# EasyEDA Pro project 天猛星1.eprj (continued)
## Notes on the sheet (continued)
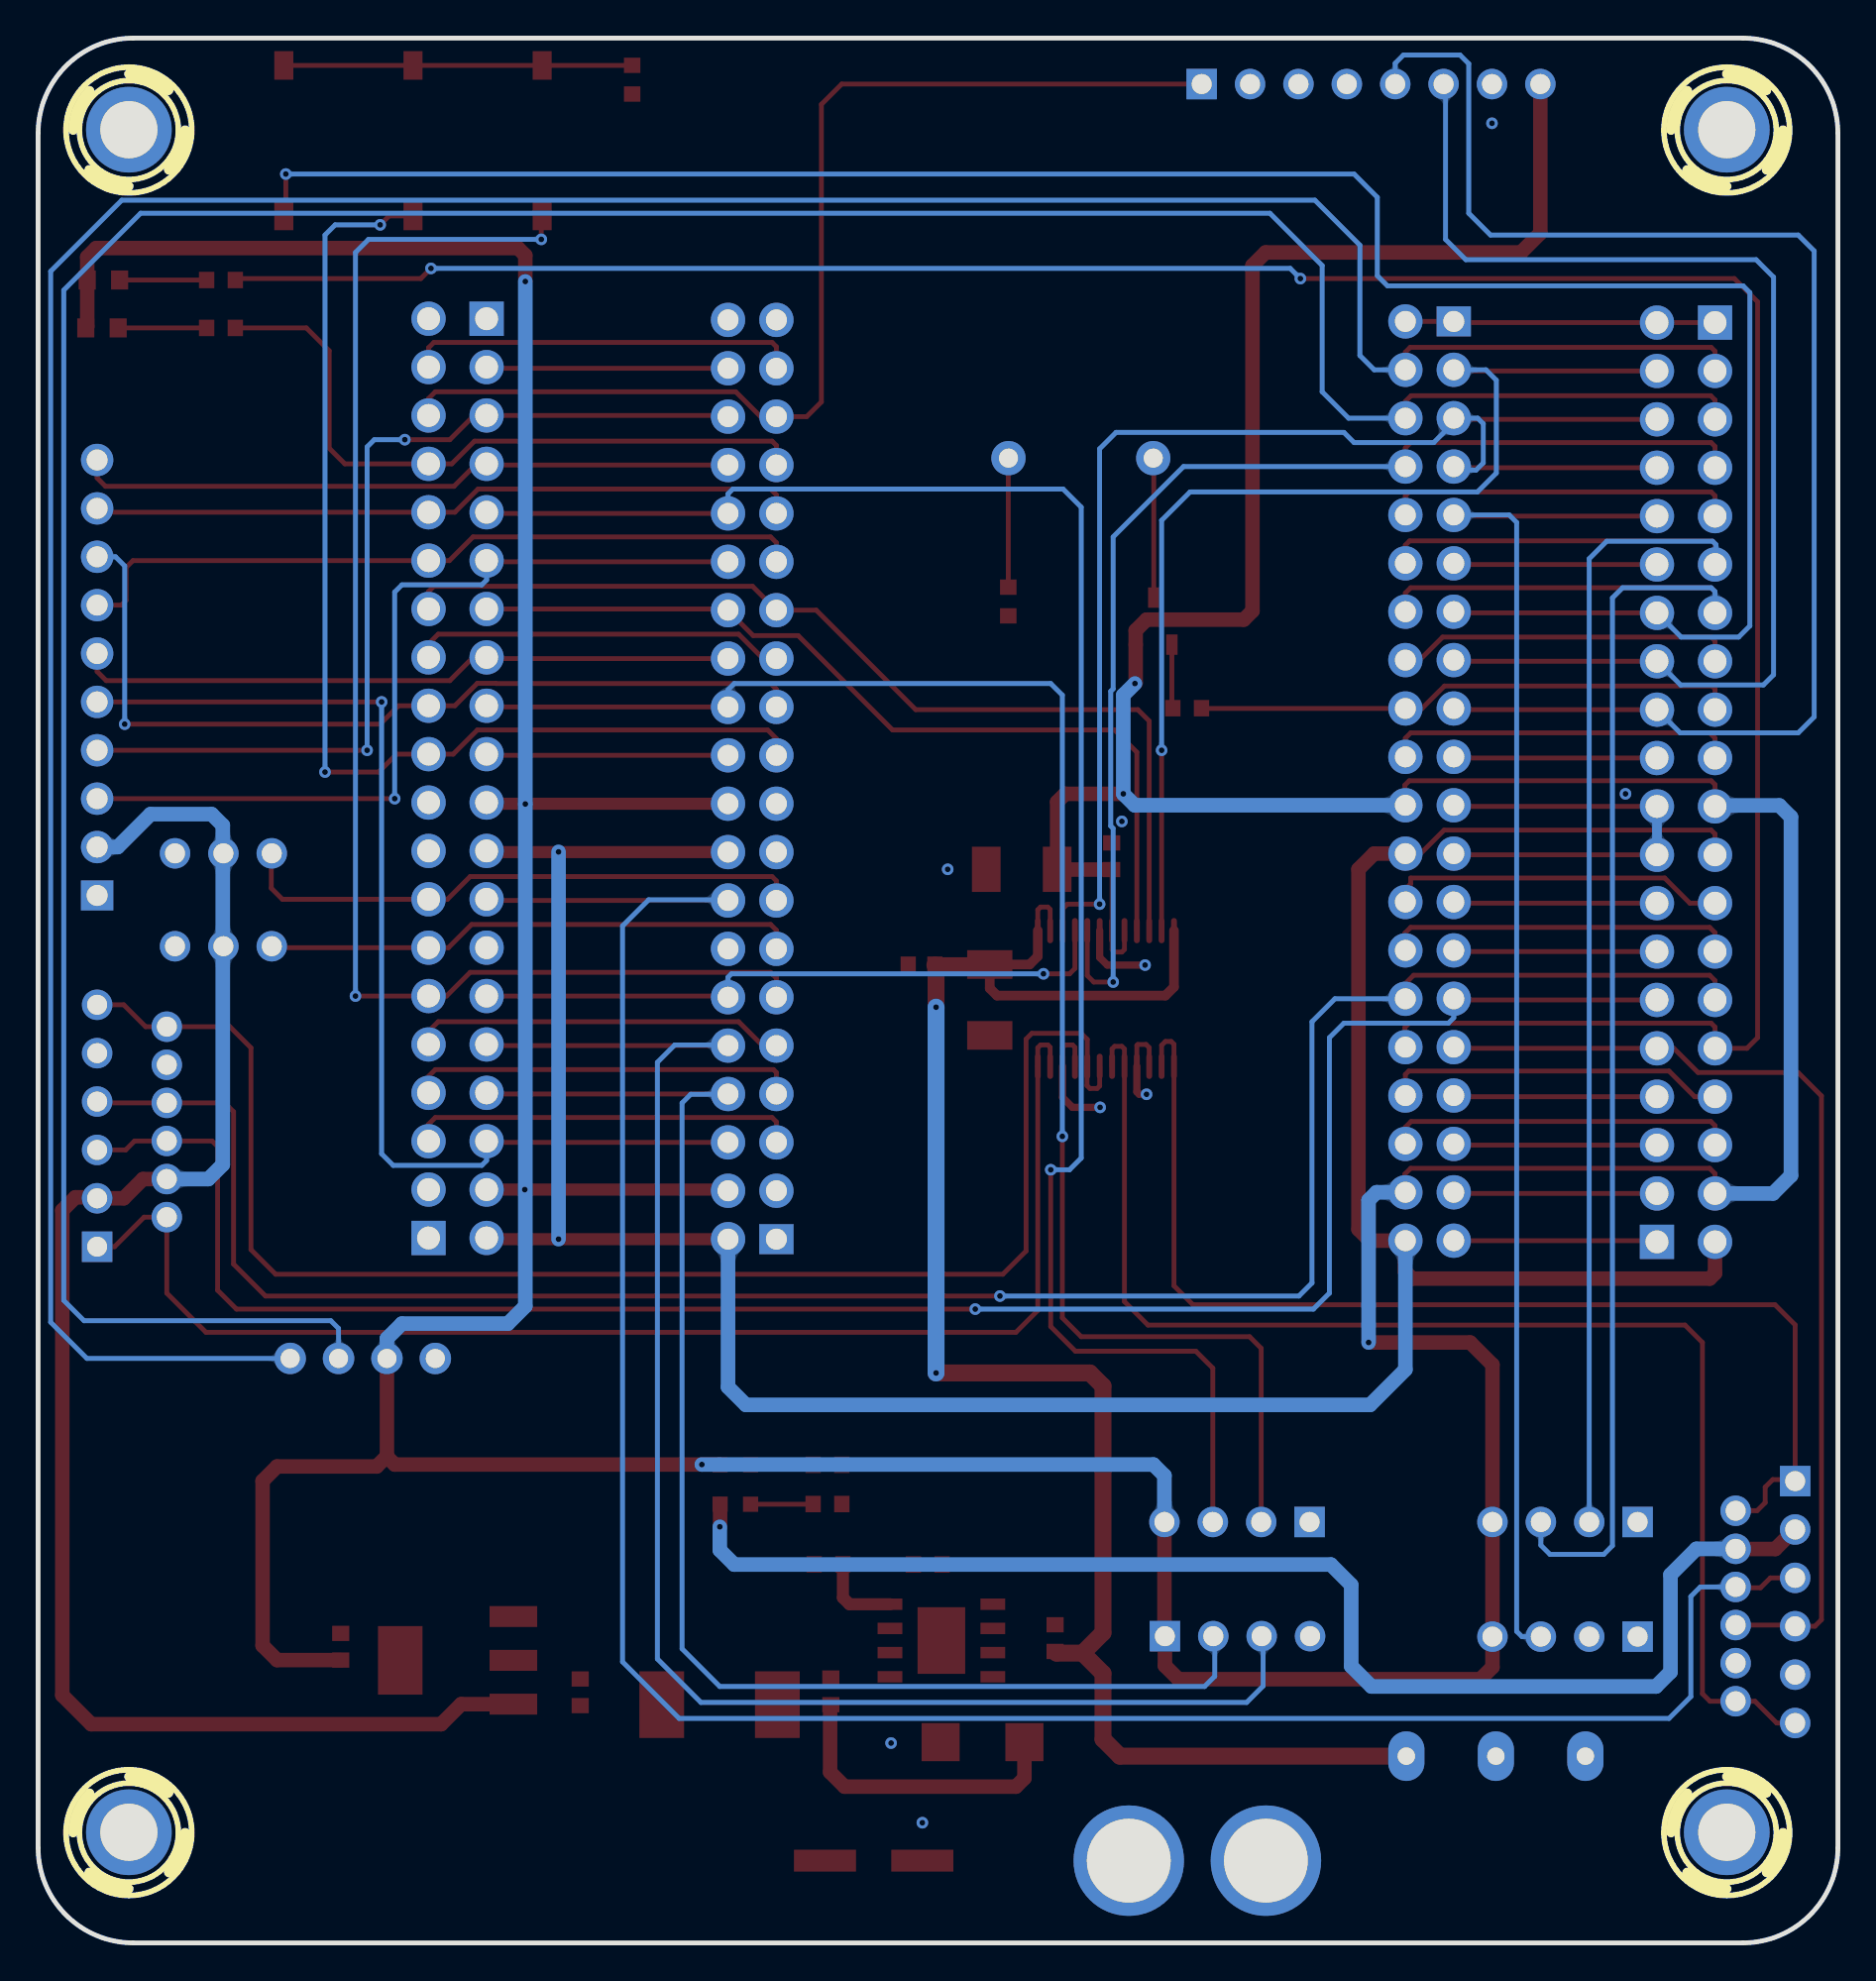
[diagram p2: board, bottom side, seen from below]

Outline 94.49 x 100 mm; copper layers: Top Layer, Bottom Layer. Coordinates in mm from the lower left corner of the outline.
Outline path: 0,95 0,5 arc(1.46,1.46) 5,0 89.49,0 arc(93.02,1.46) 94.49,5 94.49,95 arc(93.02,98.54) 89.49,100 5,100 arc(1.46,98.54) 0,95
Stack: Top Layer 0.035mm / Dielectric1 1.51mm FR4 er 4.5 / Bottom Layer 0.035mm

## Design rules (mm)
template: JLCPCB Capability(Two Layers Board)
spacing copperThickness1oz (default): track to track 0.102, other pairs 0.152 to 0.3
spacing copperThickness2oz: track to track 0.203, other pairs 0.152 to 0.3
track width copperThickness1oz (default): min 0.127, default 0.254, max 2.54
track width copperThickness2oz: min 0.203, default 0.254, max 2.54
differential pair differentialPair (default): width min 0.127, default 0.254, max 2.54; gap min 0.152, default 0.152
via viaSize (default): diameter min 0.5, default 0.61, max 10; hole min 0.3, default 0.305, max 6.3

## Placement (name value [footprint] x y rotation side)
C17  0.01uF  [C0603]  38.13 57.05 270 top
C18  10uF  [case-b_3528]  42.85 56.36 0 top
C19  0.01uF  [C0603]  48.11 51.33 180 top
C20  10uF  [case-b_3528]  44.53 49.5 270 top
C24  10uF  [C0603]  41.1 16 270 top
C25  0.01uF  [C0603]  52.87 13.21 90 top
C27  10uF  [C0603]  78.6 15.55 90 top
C28  10uF  [C0603]  66.03 13.16 270 top
C29  220uF  [CAP-SMD_BD6.3-L6.6-W6.6-LS7.2-R-RD]  50.62 4.32 0 top
D2  B340A  [SMA_L4.3-W2.6-LS5.1-RD]  44.91 10.54 0 top
H1  -  [HDR-TH_20P-P2.54-V-M-1]  6.45 60.93 270 top
H2  -  [HDR-TH_20P-P2.54-V-M-1]  9.5 60.93 90 top
H3  -  [HDR-TH_20P-P2.54-V-M-1]  73.99 61.14 90 top
H4  -  [HDR-TH_20P-P2.54-V-M-1]  70.94 61.14 270 top
H5  8路循迹  [HDR-TH_10P-P2.54-V-M]  91.39 66.42 90 top
LED3  -  [led0603_blue]  91.13 84.79 0 top
LED4  -  [led0603_blue]  91.06 87.3 0 top
LED5  -  [led_0603]  57.93 25.1 0 top
LED6  -  [led_0603]  57.93 23.04 0 top
MPU6050  -  [MPU6050-8p]  30.73 97.59 180 top
Q1  S8550  [SOT-23-3_L2.9-W1.6-P1.90-LS2.8-BR]  35.92 69.39 270 top
R8  10K  [R0603]  63.3 97.82 270 top
R9  100Ω  [R0603]  43.56 70.42 90 top
R10  100Ω  [R0603]  34.16 64.82 180 top
R11  4.7kΩ  [R0603]  84.89 84.79 180 top
R12  4.7kΩ  [R0603]  84.89 87.3 180 top
R13  10kΩ  [R0603]  53.05 23.04 180 top
R14  4.7kΩ  [R0603]  53.05 25.1 180 top
R15  10kΩ  [R0603]  52.99 19.87 0 top
R16  3.24kΩ  [R0603]  47.78 19.87 0 top
SCROW3  CON1  [LQ_SCROW3&5MM]  5.83 95.19 0 top
SCROW4  CON1  [LQ_SCROW3&5MM]  5.83 5.81 0 top
SCROW5  CON1  [LQ_SCROW3&5MM]  89.72 95.19 0 top
SCROW6  CON1  [LQ_SCROW3&5MM]  89.72 5.81 0 top
SW6  轻触按键3*6*2.5  [SW-SMD_L6.0-W3.6-LS8.0]  68.03 94.62 90 top
SW8  轻触按键3*6*2.5  [SW-SMD_L6.0-W3.6-LS8.0]  74.81 94.62 90 top
SW9  轻触按键3*6*2.5  [SW-SMD_L6.0-W3.6-LS8.0]  81.59 94.62 90 top
U4  LCKFB-TMX-MSPM0G3507  [COMM-TH_LCKFB-TMX-MSPM0G3507]  39.22 61.04 0 top
U5  -  [0.96OLED_4P]  77.44 30.68 0 top
U12  -  [拨动开关]  22.66 9.8 180 top
U17  TB6612FNG,C,8,EL  [SSOP-24_L8.3-W5.6-P0.65-LS7.6-BL]  38.43 49.58 0 top
U19  -  [XH2.54_4p]  15.72 22.23 0 top
U20  -  [XH2.54_4p]  32.94 22.23 0 top
U21  -  [X2.54_3p]  83.49 57.2 0 top
U22  -  [X2.54_3p]  83.49 52.32 0 top
U23  -  [XH2.54_6p]  1.99 17.13 270 top
U24  -  [XH2.54_6p]  91.64 43.66 90 top
U25  -  [XH2.54_4p]  15.72 16.21 0 top
U26  -  [XH2.54_4p]  30.12 15.98 180 top
U28  2.6kHz  [BUZ-TH_BD12.0-P7.60-D0.6-FD]  39.74 77.95 0 top
U29  -  [ph2.0]  5.37 17.61 270 top
U30  -  [ph2.0]  87.73 43.18 90 top
U31  AMS1117-3.3  [SOT-223-3_L6.5-W3.4-P2.30-LS7.0-BR]  72.5 14.83 180 top
U32  XT60  [CONN-TH_XT60]  33.63 4.32 180 top
U33  TPS5430DDAR  [ESOP-8_L4.9-W3.9-P1.27-LS6.0-TL-EP]  47.07 15.88 180 top
U34  15uH  [IND-SMD_L6.6-W6.6]  58.71 12.51 180 top

## Footprints (pads in the part's own frame, mm; a bottom-side part is the same pattern mirrored in y, then rotated)
0.96OLED_4P
  round 1.65 hole 1: 1(-3.81,-0.002) 2(-1.27,0.002) 3(1.27,0.002) 4(3.81,0.002)
BUZ-TH_BD12.0-P7.60-D0.6-FD
  round 1.8 hole 1: 1(-3.8,0) 2(3.8,0)
C0603
  rect 0.8x0.9 smd: 1(-0.7,0) 2(0.7,0)
CAP-SMD_BD6.3-L6.6-W6.6-LS7.2-R-RD
  rect 3.26x1.15 smd: 1(2.555,0) 2(-2.555,0)
case-b_3528
  rect 1.506x2.376 smd: 1(-1.861,0) 2(1.861,0)
COMM-TH_LCKFB-TMX-MSPM0G3507
  rect 1.8x1.575 hole 1.1: 1(-19.05,24.09) 41(16.51,-24.09)
  round 1.8 hole 1.1: 2(-16.51,24.09) 3(-19.05,21.549) 4(-16.51,21.549) 5(-19.05,19.009) 6(-16.51,19.009) 7(-19.05,16.47) 8(-16.51,16.47) 9(-19.05,13.93) 10(-16.51,13.93) 11(-19.05,11.389) 12(-16.51,11.389) 13(-19.05,8.85) 14(-16.51,8.85) 15(-19.05,6.309) 16(-16.51,6.309) 17(-19.05,3.769) 18(-16.51,3.769) 19(-19.05,1.23) 20(-16.51,1.23) 21(-19.05,-1.31) 22(-16.51,-1.31) 23(-19.05,-3.85) 24(-16.51,-3.85) 25(-19.05,-6.391) 26(-16.51,-6.391) 27(-19.05,-8.931) 28(-16.51,-8.931) 29(-19.05,-11.47) 30(-16.51,-11.47) 31(-19.05,-14.011) 32(-16.51,-14.011) 33(-19.05,-16.55) 34(-16.51,-16.55) 35(-19.05,-19.09) 36(-16.51,-19.09) 37(-19.05,-21.631) 38(-16.51,-21.631) 39(-19.05,-24.171) 40(-16.51,-24.171) 42(19.05,-24.09) 43(16.51,-21.549) 44(19.05,-21.549) 45(16.51,-19.009) 46(19.05,-19.009) 47(16.51,-16.47) 48(19.05,-16.47) 49(16.51,-13.93) 50(19.05,-13.93) 51(16.51,-11.389) 52(19.05,-11.389) 53(16.51,-8.85) 54(19.05,-8.85) 55(16.51,-6.309) 56(19.05,-6.309) 57(16.51,-3.769) 58(19.05,-3.769) 59(16.51,-1.23) 60(19.05,-1.23) 61(16.51,1.31) 62(19.05,1.31) 63(16.51,3.85) 64(19.05,3.85) 65(16.51,6.391) 66(19.05,6.391) 67(16.51,8.931) 68(19.05,8.931) 69(16.51,11.47) 70(19.05,11.47) 71(16.51,14.011) 72(19.05,14.011) 73(16.51,16.55) 74(19.05,16.55) 75(16.51,19.09) 76(19.05,19.09) 77(16.51,21.631) 78(19.05,21.631) 79(16.51,24.171) 80(19.05,24.171)
CONN-TH_XT60
  round 5.8 hole 4.4: 1(-3.6,0) 2(3.6,0)
ESOP-8_L4.9-W3.9-P1.27-LS6.0-TL-EP
  rect 1.3x0.6 smd: 1(-2.7,1.905) 2(-2.7,0.635) 3(-2.7,-0.635) 4(-2.7,-1.905) 5(2.7,-1.905) 6(2.7,-0.635) 7(2.7,0.635) 8(2.7,1.905)
  rect 2.5x3.5 smd: 9(0,0)
HDR-TH_10P-P2.54-V-M
  rect 1.575x1.7 hole 1.1: 1(-11.43,0)
  round 1.7 hole 1.1: 2(-8.89,0) 3(-6.35,0) 4(-3.81,0) 5(-1.27,0) 6(1.27,0) 7(3.81,0) 8(6.35,0) 9(8.89,0) 10(11.43,0)
HDR-TH_20P-P2.54-V-M-1
  rect 1.8x1.8 hole 1.2: 1(-24.13,0)
  round 1.8 hole 1.2: 2(-21.59,0) 3(-19.05,0) 4(-16.51,0) 5(-13.97,0) 6(-11.43,0) 7(-8.89,0) 8(-6.35,0) 9(-3.81,0) 10(-1.27,0) 11(1.27,0) 12(3.81,0) 13(6.35,0) 14(8.89,0) 15(11.43,0) 16(13.97,0) 17(16.51,0) 18(19.05,0) 19(21.59,0) 20(24.13,0)
IND-SMD_L6.6-W6.6
  rect 2.35x3.5 smd: 1(-3.035,0) 2(3.035,0)
led0603_blue
  rect 0.9x1 smd: 1(-0.85,0) 2(0.85,0)
led_0603
  rect 0.8x0.8 smd: 1(-0.851,-0.01) 2(0.75,-0.005)
LQ_SCROW3&5MM
  round 4.5 hole 3: 1(0,0)
MPU6050-8p
  rect 1.6x1.6 hole 1.05: 1(-2.667,0)
  round 1.6 hole 1.05: 2(-0.127,0) 3(2.413,0) 4(4.953,0) 5(7.493,0) 6(10.033,0) 7(12.573,0) 8(15.113,0)
ph2.0
  round 1.6 hole 1.05: 1(-5.08,0) 2(-3.08,0) 3(-1.08,0) 4(0.92,0) 5(2.92,0) 6(4.92,0)
R0603
  rect 0.806x0.864 smd: 1(-0.753,0) 2(0.753,0)
SMA_L4.3-W2.6-LS5.1-RD
  rect 2x2 smd: 1(-2.2,0) 2(2.2,0)
SOT-23-3_L2.9-W1.6-P1.90-LS2.8-BR
  rect 1.07x0.6 smd: 1(1.235,-0.95) 2(1.235,0.95) 3(-1.235,0)
SOT-223-3_L6.5-W3.4-P2.30-LS7.0-BR
  rect 2.5x1.1 smd: 1(2.97,-2.3) 2(2.97,0) 3(2.97,2.3)
  rect 2.34x3.6 smd: 4(-2.97,0)
SSOP-24_L8.3-W5.6-P0.65-LS7.6-BL
  oval 0.308x1.324 smd: 1(-3.575,-3.562) 2(-2.925,-3.562) 3(-2.275,-3.562) 4(-1.625,-3.562) 5(-0.975,-3.562) 6(-0.325,-3.562) 7(0.325,-3.562) 8(0.975,-3.562) 9(1.625,-3.562) 10(2.275,-3.562) 11(2.925,-3.562) 12(3.575,-3.562) 13(3.575,3.562) 14(2.925,3.562) 15(2.275,3.562) 16(1.625,3.562) 17(0.975,3.562) 18(0.325,3.562) 19(-0.325,3.562) 20(-0.975,3.562) 21(-1.625,3.562) 22(-2.275,3.562) 23(-2.925,3.562) 24(-3.575,3.562)
SW-SMD_L6.0-W3.6-LS8.0
  rect 1.5x1 smd: 1(-3.95,0) 2(3.95,0)
X2.54_3p
  round 1.6 hole 1.05: 1(-1.27,0) 2(1.27,0) 3(3.81,0)
XH2.54_4p
  rect 1.6x1.6 hole 1.05: 1(-5.207,-0.127)
  round 1.6 hole 1.05: 2(-2.667,-0.127) 3(-0.127,-0.127) 4(2.413,-0.127)
XH2.54_6p
  rect 1.6x1.6 hole 1.05: 1(-7.112,0.254)
  round 1.6 hole 1.05: 2(-4.572,0.254) 3(-2.032,0.254) 4(0.508,0.254) 5(3.048,0.254) 6(5.588,0.254)
拨动开关
  oval 1.9x2.6 hole 0.914: 1(0,0) 2(4.7,0) 3(9.4,0)

## Nets
As in the schematic, except:
3V3: C17.2 C18.1 C27.1 H1.11 H1.19 H4.11 H4.19 LED3.2 LED4.2 LED5.2 MPU6050.8 Q1.2 U4.22 U4.38 U4.44 U4.60 U5.2 U17.19 U17.20 U19.4 U20.4 U25.4 U26.1 U31.2 U31.4
GND: C17.1 C18.2 C19.1 C20.2 C24.1 C27.2 C28.1 C29.2 D2.2 H1.1 H2.1 H2.2 H2.9 H2.10 H2.20 H3.1 H3.2 H3.9 H3.10 H3.20 H4.1 H4.14 H5.1 MPU6050.7 R8.2 R9.1 R13.2 R14.2 R16.1 U4.1 U4.2 U4.21 U4.23 U4.37 U4.39 U4.41 U4.43 U4.54 U4.57 U4.59 U4.79 U4.80 U5.1 U17.3 U17.4 U17.9 U17.10 U17.18 U19.1 U20.1 U21.3 U22.3 U23.5 U24.5 U25.1 U26.4 U29.5 U30.5 U31.1 U32.1 U33.6 U33.9
MPU_IN: H3.18 MPU6050.1 U4.75
MPU_SCL: H2.13 MPU6050.6 U4.15
MPU_SDA: H2.12 MPU6050.5 U4.17
OLED_SCL: H1.3 U4.6 U5.3
OLED_SDA: H1.2 U4.4 U5.4

Pads without a net: MPU6050 2 3 4; SCROW3 1; SCROW4 1; SCROW5 1; SCROW6 1; U12 3; U33 2 3 5

## Via types
v1: diameter 0.61, hole 0.305, Top Layer to Bottom Layer, 41 vias

## Routing (per net, layer and track width the routed paths; a pad name or vN(x,y) marks a point on that pad's centre or on a via; arc(x,y) is an arc through that point)
3V3: length 397.2
  Top Layer w0.254: 37.45,53.14 37.45,52.16 37.59,52.02 37.97,52.02 38.11,52.15 U17.19 38.11,56.33 C17.2 ; 22.71,59.73 22.73,59.75 22.73,60.78 22.5,61.01 6.65,61.01 6.45,60.81 H1.11 ; H1.19 6.45,40.39 6.73,40.67 22.43,40.67 22.73,40.36 22.73,39.43 22.71,39.41
  Top Layer w0.635: H4.11 70.88,59.81 U4.60 ; U4.44 58.33,39.55 v1(68.94,39.55) H4.19
  Top Layer w0.762: 76.17,25.55 76.71,25.01 81.94,25.01 82.7,24.25 82.7,15.61 81.94,14.85 C27.1 ; 76.17,25.55 U5.2 ; 76.17,25.55 76.17,25.53 75.76,25.11 v1(59.64,25.11) 58.7,25.11 LED5.2 ; U20.4 35.36,16.13 U26.1 35.33,14.55 34.62,13.84 18.77,13.84 18.14,14.48 U25.4 U19.4 18.14,30.35 19.3,31.52 v1(24.64,31.52) ; LED3.2 91.91,84.86 LED4.2 91.91,88.51 91.44,88.98 69.29,88.98 68.91,88.6 v1(68.91,87.22) ; 15.62,97.59 15.62,89.76 16.64,88.75 30.05,88.75 30.73,88.06 30.73,69.93 31.19,69.47 36.3,69.47 36.87,68.9 36.87,66.16 v1(36.91,66.12) ; v1(37.52,60.33) 40.56,60.33 40.99,59.9 C18.1 40.97,56.35 C17.2
  Bottom Layer w0.762: v1(36.91,66.12) 37.52,65.51 v1(37.52,60.33) 36.92,59.73 22.71,59.73 ; U5.2 76.17,31.72 75.39,32.51 69.82,32.51 68.91,33.43 v1(68.91,59.79) v1(68.91,87.22) ; v1(59.64,25.11) 35.93,25.11 35.36,24.54 U20.4 ; v1(24.64,31.52) 24.64,38.99 24.22,39.41 22.71,39.41 ; H1.11 6.4,59.72 3.07,59.72 2.46,59.11 2.46,40.28 3.4,39.34 H1.19
5V: length 159.2
  Top Layer w0.254: 22.71,57.19 21.91,57.19 20.68,58.42 6.65,58.42 6.45,58.22 H1.12
  Top Layer w0.635: U4.42 v1(67.16,36.95) 70.88,36.95 H4.20 ; U4.58 70.88,57.27 H4.12
  Top Layer w0.762: H1.20 6.45,35.15 6.73,34.87 22.35,34.87 22.73,35.26 22.73,36.84 22.71,36.87 24.57,36.87 25.17,37.47 25.17,56.36 24.35,57.19 22.71,57.19
  Bottom Layer w0.762: v1(67.16,36.95) v1(67.16,57.28) ; 22.71,36.87 22.71,30.1 24.56,28.25 57.33,28.25 58.27,29.18 U4.42
+5V: length 155.8
  Top Layer w0.762: U31.3 72.28,12.53 73.33,11.48 91.69,11.48 93.22,13.01 93.22,38.46 92.53,39.14 91.44,39.14 U24.2 89.99,39.09 88.98,40.1 U30.2 ; 2.28,21.69 3.29,20.68 5.43,20.68 ; v1(58.7,21.84) 58.68,21.86 LED6.2
  Bottom Layer w0.762: U29.2 7.43,20.69 8.79,19.33 8.79,14.22 9.55,13.46 24.49,13.46 25.55,14.53 25.55,18.8 26.62,19.86 57.94,19.86 58.7,20.62 v1(58.7,21.84) ; U30.2 85.55,40.1 84.79,40.86 84.79,58.67 85.38,59.26 88.58,59.26 90.31,57.53 H5.2
+12V: length 91.6
  Top Layer w0.254: U17.14 41.36,54.26 41.48,54.38 41.86,54.38 42.01,54.24 U17.13
  Top Layer w0.508: U17.13 42.01,51.8 42.44,51.37 C20.1 44.53,50.11 44.14,49.73 35.31,49.73 34.85,50.18 34.85,53.14
  Top Layer w0.762: C20.1 47.33,51.37
  Top Layer w0.889: U12.1 37.69,9.8 38.58,10.69 38.58,14.15 39.65,15.21 ; v1(47.35,29.92) 39.27,29.92 38.58,29.24 38.58,16.28 39.65,15.21 ; 39.65,15.21 41.02,15.21 41.03,15.23 ; C19.2 47.35,51.27 v1(47.35,49.12)
  Bottom Layer w0.889: v1(47.35,29.92) v1(47.35,49.12)
GND: length 76.9
  Top Layer w0.254: H2.1 9.56,36.87 20.17,36.87 ; 20.17,57.19 20.11,57.12 H2.9 ; 70.88,85.21 H4.1 ; H1.1 H2.20 20.11,85.06 20.17,85.13 22.71,85.13 ; U17.10 40.71,47 40.56,47.14 40.18,47.14 40.06,47.02 40.06,46.02 ; U17.3 36.16,47 36.32,47.17 36.75,47.17 36.81,47.12 U17.4 ; H2.2 20.11,39.34 20.17,39.41 ; H2.10 20.11,59.66 20.17,59.73
  Top Layer w0.381: U17.4 36.81,44.68 36.68,44.55 v1(36.3,44.55) ; v1(38.73,43.87) 40.18,43.87 40.71,44.39 U17.10 ; 38.76,53.14 38.76,51.73 38.35,51.33 v1(36.37,51.33)
  Bottom Layer w0.508: H2.10 H2.9
  vias: v1(11.15,60.33) v1(18.16,95.53) v1(37.59,58.88) v1(46.74,56.36) v1(48.06,6.31) v1(49.71,10.49)
AIN1: length 46.6
  Top Layer w0.254: H4.7 58.33,70.03 U4.68 58.27,69.95 56.95,68.63 54.58,68.63 49.63,63.68 37.97,63.68 36.81,62.51 U17.21
AIN2: length 52.8
  Top Layer w0.254: H3.14 73.99,70.94 73.71,71.22 56.98,71.22 U4.67 53.63,69.97 48.41,64.74 36.75,64.74 36.16,64.15 U17.22
AO1: length 60.7
  Top Layer w0.254: U29.1 5.43,22.69 ; 5.43,22.69 5.43,22.69 ; 5.43,22.69 5.45,22.67 ; 5.43,22.69 5.36,22.76 ; 5.43,22.69 4.24,22.69 3.82,23.11 3.82,23.93 3.42,24.32 2.31,24.32 ; U23.1 2.24,32.45 3.3,33.5 33.86,33.5 34.85,34.5 34.85,47.18 35,47.32 35.31,47.32 35.5,47.13 U17.2
AO2: length 70.1
  Top Layer w0.254: U23.6 3.21,11.54 4.36,12.69 U29.6 6.72,12.69 7.11,13.08 7.11,31.52 8.03,32.44 36.22,32.44 37.45,33.67 37.45,46.93 37.59,47.07 37.97,47.07 38.11,46.94 U17.6
BIN1: length 62.8
  Top Layer w0.254: U17.17 39.41,50.78 39.06,50.44 v1(38.05,50.44) ; 22.71,77.51 22.71,78.49 22.43,78.77 6.65,78.77 6.45,78.56 H1.4
  Bottom Layer w0.254: v1(38.05,50.44) 38.05,58.51 38.18,58.64 38.18,65.71 38.05,65.84 38.05,73.81 34.36,77.51 22.71,77.51
BIN2: length 34.1
  Top Layer w0.254: H4.15 58.33,49.71 U4.52 ; v1(41.71,50.88) 40.34,50.88 40.06,51.16 40.06,53.14
  Bottom Layer w0.254: v1(41.71,50.88) 58.09,50.88 58.27,50.7 58.27,49.65 U4.52
BO1: length 70.9
  Top Layer w0.254: U17.11 41.36,47.02 41.48,47.14 41.86,47.14 42.01,47 U17.12 42.01,33.2 43.15,32.06 85.67,32.06 87.73,34.11 U30.1 88.93,38.1 90.47,36.55 U24.1
BO2: length 80.2
  Top Layer w0.254: 38.76,46.02 38.76,44.99 38.89,44.86 39.27,44.86 39.42,45.01 39.42,46 U17.8 39.41,47.43 39.73,47.75 42.32,47.75 42.62,47.45 42.62,36.32 43.84,35.1 82.02,35.1 83.31,36.4 83.31,46.99 84.42,48.1 U30.6 88.84,48.1 89.99,49.25 U24.6
BUZZER: length 28.6
  Top Layer w0.254: H1.9 6.45,65.84 6.6,65.99 20.66,65.99 21.83,64.81 33.39,64.81 R10.2
ECHO: length 83.8
  Top Layer w0.254: H4.16 70.88,47.11 U4.50
  Bottom Layer w0.254: 30.17,16.1 30.17,13.49 31.04,12.62 59.69,12.62 61.98,14.91 61.98,46.23 61.06,47.14 58.3,47.14 U4.50
KEY1: length 74.1
  Top Layer w0.254: v1(77.83,49.71) H3.6 73.05,49.71 71.81,50.95 56.03,50.95 55.73,50.65 U4.51 ; v1(68.07,89.43) 68.07,90.62 SW6.1
  Bottom Layer w0.254: v1(77.83,49.71) 77.83,88.75 77.14,89.43 v1(68.07,89.43)
KEY2: length 58.9
  Top Layer w0.254: SW8.1 76.06,90.67 v1(76.53,90.2) ; U4.61 55.73,63.22 56.19,63.68 71.42,63.68 72.69,62.41 H3.11 75.67,62.41 76.61,61.47 v1(79.43,61.47)
  Bottom Layer w0.254: v1(79.43,61.47) 79.43,89.66 78.89,90.2 v1(76.53,90.2)
KEY3: length 117.9
  Top Layer w0.254: SW9.1 81.48,90.77 v1(81.48,92.86) ; 20.17,69.89 20.11,69.82 H2.14
  Bottom Layer w0.254: v1(81.48,92.86) 25.4,92.86 24.18,91.64 24.18,87.53 23.65,87 4.98,87 4.62,86.64 4.62,69.14 5.21,68.55 8.23,68.55 H2.14
L1: length 34.8
  Top Layer w0.254: U4.66 70.88,67.43 H4.8 71.65,67.49 72.87,66.27 90.91,66.27 91.39,66.75 H5.6
L2: length 58.2
  Top Layer w0.254: U4.46 70.88,42.03 H4.18 ; H5.5 v1(76.45,65.15)
  Bottom Layer w0.254: v1(76.45,65.15) 76.45,41.43 75.84,40.82 71.2,40.82 70.94,41.07 H4.18
L3: length 49.8
  Top Layer w0.254: v1(75.23,78.92) 72.87,78.92 71.6,80.19 H4.3 58.33,80.19 U4.76 ; H5.4 v1(77.22,62.61)
  Bottom Layer w0.254: v1(77.22,62.61) 77.22,78.54 76.84,78.92 v1(75.23,78.92)
L4: length 45.3
  Top Layer w0.254: H4.6 70.88,72.51 U4.70 ; H5.3 v1(75.77,60.07)
  Bottom Layer w0.254: v1(75.77,60.07) 75.77,70.92 75.39,71.3 71.2,71.3 70.94,71.55 70.94,72.57 H4.6
L_ENCA: length 105.4
  Top Layer w0.254: 20.17,49.57 20.11,49.5 H2.6 ; v1(45.29,33.27) 84.07,33.27 85.06,34.26 85.06,41.81 85.36,42.1 U30.3 89.42,42.1 89.89,41.63 U24.3
  Bottom Layer w0.254: 20.17,49.57 20.17,48.57 20.45,48.29 25.93,48.29 26.7,47.52 26.7,34.11 27.53,33.27 v1(45.29,33.27)
L_ENCB: length 110.5
  Top Layer w0.254: U24.4 91.32,44.1 U30.4 84.69,44.1 84.23,43.64 84.23,35.64 82.55,33.96 v1(43.99,33.96) ; H1.15 6.45,50.52 6.73,50.8 22.28,50.8 22.71,50.37 22.71,49.57
  Bottom Layer w0.254: v1(43.99,33.96) 28.3,33.96 27.61,34.65 27.61,48.36 26.41,49.57 22.71,49.57
LED3: length 36
  Top Layer w0.254: R11.2 80.4,84.79 79.21,83.59 79.21,78.47 78.38,77.65 H3.17 72.77,77.65 71.58,78.84 55.96,78.84 55.73,78.61 U4.73
LED4: length 140.6
  Top Layer w0.254: v1(73.86,87.91) 74.4,87.38 84.06,87.38 R12.2 ; v1(28.22,87.38) 5.44,87.38 4.22,86.16 4.22,47.52 4.77,46.96 H1.16 6.45,48.08 6.65,48.29 22.5,48.29 22.73,48.06 22.73,47.05 22.71,47.03
  Bottom Layer w0.254: v1(73.86,87.91) 28.75,87.91 v1(28.22,87.38)
MPU_IN: length 58.5
  Top Layer w0.254: H3.18 73.99,81.08 73.63,81.43 57.86,81.43 56.56,80.13 U4.75 54.14,80.13 53.37,80.9 53.37,96.52 52.3,97.59 MPU6050.1
MPU_SCL: length 64.7
  Top Layer w0.254: H2.13 20.11,67.28 20.17,67.35
  Bottom Layer w0.254: 20.7,97.59 20.6,97.49 20.6,89.43 19.53,88.37 4.29,88.37 3.38,87.45 3.38,66.57 3.91,66.04 8.25,66.04 H2.13
MPU_SDA: length 76.4
  Top Layer w0.254: 20.17,64.81 20.11,64.74 H2.12
  Bottom Layer w0.254: H2.12 8.28,63.53 2.08,63.53 1.24,64.36 1.24,88.82 2.08,89.66 18.24,89.66 19.38,90.81 19.38,98.65 19.84,99.11 22.81,99.11 23.24,98.68 23.24,97.59
OLED_SCL: length 168.5
  Top Layer w0.254: H1.3 6.45,81 6.68,81.23 22.41,81.23 22.71,80.92 22.71,80.05
  Bottom Layer w0.254: U5.3 78.71,32.26 79.12,32.66 92.07,32.66 93.14,33.73 93.14,86.77 89.1,90.81 29.82,90.81 27.08,88.06 27.08,81.43 25.69,80.05 22.71,80.05
OLED_SDA: length 166.7
  Top Layer w0.254: H1.2 6.45,83.56 6.65,83.77 22.45,83.77 22.71,83.51 22.71,82.59
  Bottom Layer w0.254: U5.4 91.92,30.68 93.83,32.59 93.83,87.76 90.09,91.49 27.46,91.49 25.09,89.13 25.09,83.34 24.34,82.59 22.71,82.59
PA0: length 58.2
  Top Layer w0.254: H2.19 20.11,82.52 20.17,82.59 ; U17.23 v1(35.5,62.61)
  Bottom Layer w0.254: v1(35.5,62.61) 35.5,74.68 34.01,76.17 18.92,76.17 17.93,77.17 17.93,82.04 18.48,82.59 20.17,82.59
PA1: length 73.9
  Top Layer w0.254: 20.17,80.05 20.11,79.98 H2.18 ; 20.17,77.51 20.11,77.44 H2.17 ; v1(38.76,54.53) 40.45,54.53 40.71,54.28 U17.15
  Bottom Layer w0.254: v1(38.76,54.53) 38.76,78.44 37.9,79.3 25.93,79.3 25.4,78.77 21.22,78.77 20.05,79.93 20.17,80.05 18.91,80.05 18.62,79.76 18.62,77.7 19,77.32 19.98,77.32 20.17,77.51
PA9: length 73.8
  Top Layer w0.254: H2.16 20.11,74.9 20.17,74.97
  Bottom Layer w0.254: 20.17,74.97 17.26,74.97 16.87,74.57 16.87,16.36 16.59,16.08 U25.3
PA10: length 77.2
  Top Layer w0.254: H1.6 6.45,73.46 6.6,73.61 22.48,73.61 22.71,73.38 22.71,72.43
  Bottom Layer w0.254: H1.6 6.4,72.42 6.4,73.4 6.58,73.58 12.14,73.58 13.06,72.67 U19.2
PA11: length 80.5
  Top Layer w0.254: H1.7 6.45,70.94 6.65,71.15 22.43,71.15 22.71,70.87 22.71,69.89
  Bottom Layer w0.254: H1.7 6.45,70.94 6.65,71.15 11.3,71.15 11.84,70.61 11.84,20.85 12.29,20.4 15.11,20.4 15.6,20.88 U19.3
PA14: length 39.3
  Top Layer w0.254: U4.69 55.73,73.51 56.03,73.81 71.65,73.81 72.9,72.57 H3.15 89.51,72.57 89.86,72.21 89.86,70.49 90.12,70.23 H5.7
PA21: length 84.5
  Top Layer w0.254: v1(40.72,42.34) 40.72,32.82 39.73,31.83 30.89,31.83 30.28,31.22 U20.2 ; U4.64 70.88,64.89 H4.9
  Bottom Layer w0.254: v1(40.72,42.34) 40.72,65.51 41.33,66.12 57.94,66.12 58.27,65.79 U4.64
PA22: length 94.5
  Top Layer w0.254: 32.82,22.1 32.82,30.18 33.71,31.06 40.03,31.06 41.33,32.36 v1(41.33,40.59) ; H4.5 70.88,75.05 U4.72
  Bottom Layer w0.254: U4.72 58.27,76.07 58.01,76.33 40.68,76.33 39.73,75.37 39.73,41.2 40.34,40.59 v1(41.33,40.59)
PA23: length 12.7
  Top Layer w0.254: U4.62 70.88,62.35 H4.10
PA26: length 12.7
  Top Layer w0.254: U4.78 70.88,82.67 H4.2
PA27: length 20.6
  Top Layer w0.254: H3.19 73.99,83.74 73.71,84.02 55.96,84.02 55.73,83.79 U4.77
PA29: length 18
  Top Layer w0.254: 22.71,44.49 22.71,45.59 22.53,45.77 8.86,45.77 7.52,44.42 H1.17
PA30: length 28.1
  Top Layer w0.254: U4.53 55.73,53.16 56.03,53.47 71.73,53.47 72.95,52.25 H3.7 82.14,52.25 U22.1
PB5: length 18.5
  Top Layer w0.254: 22.71,74.97 22.71,75.97 22.5,76.17 6.65,76.17 6.45,75.97 H1.5
PB6: length 10.7
  Top Layer w0.254: 20.17,54.65 20.11,54.58 H2.8
PB7: length 17.9
  Top Layer w0.254: 22.71,54.65 22.71,55.32 22.43,55.6 22.43,55.91 9.09,55.91 7.77,54.58 H1.13
PB8: length 10.7
  Top Layer w0.254: 20.17,52.11 20.11,52.04 H2.7
PB9: length 18.4
  Top Layer w0.254: H1.14 6.45,53.04 6.73,53.31 22.43,53.31 22.73,53.01 22.73,52.13 22.71,52.11
PB10: length 19.7
  Top Layer w0.254: U4.49 56.45,47.11 57.71,48.36 73.48,48.36 73.99,47.85 H3.5
PB11: length 20.5
  Top Layer w0.254: H3.4 73.99,45.49 73.63,45.85 55.88,45.85 55.73,45.69 U4.47
PB12: length 17.9
  Top Layer w0.254: H1.8 6.45,68.35 6.65,68.55 20.75,68.55 21.96,67.35 22.71,67.35
PB14: length 75.1
  Top Layer w0.254: U4.48 70.88,44.57 H4.17
  Bottom Layer w0.254: U4.48 58.28,44.55 60.22,44.55 60.68,44.09 60.68,15.44 58.7,13.46 33.25,13.46 32.72,14 32.72,16.1
PB15: length 10.7
  Top Layer w0.254: 20.17,72.43 20.11,72.36 H2.15
PB17: length 19.7
  Top Layer w0.254: U4.65 56.43,67.43 57.71,68.71 73.48,68.71 73.99,68.2 H3.13
PB19: length 46.1
  Top Layer w0.254: v1(89.94,63.98) 76.53,63.98 75.56,64.95 H3.12 72.61,64.95 71.43,66.13 70.45,66.13 70.44,66.12 56.03,66.12 55.73,65.81 U4.63
  Bottom Layer w0.254: H5.8 90.42,72.77 89.94,72.29 v1(89.94,63.98)
PB20: length 37.4
  Top Layer w0.254: H5.9 91.19,75.11 H3.16 72.61,75.11 71.39,76.33 56.03,76.33 55.73,76.02 U4.71
PB21: length 30.2
  Top Layer w0.254: U21.1 82.25,57.18 82.25,55.37 81.66,54.79 H3.8 73,54.79 71.81,55.98 55.96,55.98 55.73,55.75 U4.55
PB22: length 126.4
  Top Layer w0.254: U4.56 70.88,54.73 H4.13 ; U23.3 3.54,19.16 4.06,18.64 5.32,18.64 U29.3
  Bottom Layer w0.254: U4.56 58.3,54.76 62.43,54.76 63.81,53.39 63.81,14.76 60.83,11.79 8.86,11.79 7.72,12.93 7.72,18.19 7.22,18.69 U29.3
PB23: length 52.5
  Top Layer w0.254: U29.4 2.31,16.69 U23.4 1.21,16.62 0.86,16.97 0.86,44.47 2.09,45.69 7.34,45.69 8.61,46.96 H2.5 20.11,46.96 20.17,47.03
PB24: length 34.8
  Top Layer w0.254: U4.74 70.88,77.59 H4.4 71.48,77.65 72.65,76.47 90.95,76.47 91.39,76.91 H5.10
PB27: length 10.7
  Top Layer w0.254: 20.17,44.49 20.11,44.42 H2.4
$1N3235: length 10.7
  Top Layer w0.254: 20.17,62.27 20.11,62.2 H2.11
$1N3243: length 10.7
  Top Layer w0.254: 20.17,41.95 20.11,41.88 H2.3
$1N3271: length 18.4
  Top Layer w0.254: H1.18 6.45,42.9 6.68,43.13 22.41,43.13 22.71,42.82 22.71,41.95
$1N3274: length 18.5
  Top Layer w0.254: 22.71,62.27 22.71,63.25 22.43,63.53 6.73,63.53 6.45,63.25 H1.10
$1N3374: length 20.5
  Top Layer w0.254: H3.3 73.99,42.98 73.63,43.33 55.96,43.33 55.73,43.1 U4.45
$1N5970: length 18.3
  Top Layer w0.254: SW9.2 SW8.2 SW6.2 63.3,98.57 R8.1
$1N5979: length 4.7
  Top Layer w0.254: R11.1 90.27,84.79 90.31,84.82
$1N5981: length 4.6
  Top Layer w0.254: R12.1 90.19,87.3 90.23,87.34
$1N5986: length 7.3
  Top Layer w0.254: U28.1 35.92,77.92 Q1.3
$1N5988: length 3.2
  Top Layer w0.254: 34.97,68.16 34.97,65.18 34.84,65.05
$1N5990: length 6.8
  Top Layer w0.254: U28.2 43.56,77.94 R9.2
$1N7998: length 3.3
  Top Layer w0.254: R14.1 57.07,25.1 LED5.1
$1N8000: length 3.3
  Top Layer w0.254: LED6.1 53.81,23.03 R13.1
$1N8508: length 16.1
  Top Layer w0.762: C25.1 52.91,12.47 52.91,8.97 52.15,8.2 43.15,8.2 42.71,8.65 D2.1
$1N8510: length 8.1
  Top Layer w0.635: U33.4 51.89,17.78 52.24,18.12 R15.1 52.23,19.87 R16.2

## Copper pours and planes (outline as drawn; the poured copper is in the pictures)
3V3 on Top Layer: 68.15,16.89 79.58,16.89 79.58,12.85 68.15,12.85
+5V on Top Layer: 50.88,20.83 63.19,20.83 63.19,3.05 50.88,3.05
+5V on Top Layer: 58.09,23.98 59.46,23.98 59.46,20.17 58.09,20.17
+5V on Top Layer: 62.11,13.23 71.35,13.23 71.35,11.51 62.11,11.51
+12V on Top Layer: 40.39,15.75 45.16,15.75 45.16,14.73 40.39,14.73
GND on Top Layer: -19.71,108.64 107.16,108.64 107.16,-8.94 -19.71,-8.94
GND on Top Layer: 40.34,17.27 46.3,17.27 46.3,15.98 40.34,15.98
GND on Top Layer: 45.54,20.83 48.59,20.83 48.59,9.27 45.54,9.27
GND on Top Layer: -28.4,100.79 128.5,100.79 128.5,-2.39 -28.4,-2.39
GND on Bottom Layer: -4.85,111.76 110.74,111.76 110.74,-14.5 -4.85,-14.5
VCC on Top Layer: 16.03,11.33 33.4,11.33 33.4,1.19 16.03,1.19
$1N8507 on Top Layer: 48.97,14.48 53.54,14.48 53.54,13.46 48.97,13.46
$1N8508 on Top Layer: 41.6,14.48 45.16,14.48 45.16,9.27 41.6,9.27
$1N8508 on Top Layer: 51.92,14.53 57.1,14.53 57.1,10.57 51.92,10.57

Small or netless copper shapes (teardrops, artwork), in the pictures only: 311 on Top Layer, 69 on Bottom Layer

## Text on the board
Top Silkscreen Layer: MOTOR_L | MOTOR_R | Servo | Trace | ON | + | CHIP | B04 | B26 | CLK | B07 | GND | B05 | B13 | 3V3 | B12 | B09 | A28 | A10 | A13 | A29 | A31 | A11 | 5V | G | AGND | B16 | B06 | DIO | B27 | B08 | B15 | B03 | B23 | B02 | A00 | A08 | A09 | A12 | A01 | A9 | A8 | 3V | A21 | A7 | A22 | B14 | A18 | A17 | B22 | A23 | A15 | A07 | B18 | A26 | B24 | B01 | A24 | RST | A16 | B21 | A02 | B11 | A30 | A14 | B19 | B10 | B17 | A27 | B25 | B20 | B00 | A25
